# EasyEDA Pro project STM32G303的双FOC电机驱动.eprj, board axdr_v1.2 (continued)
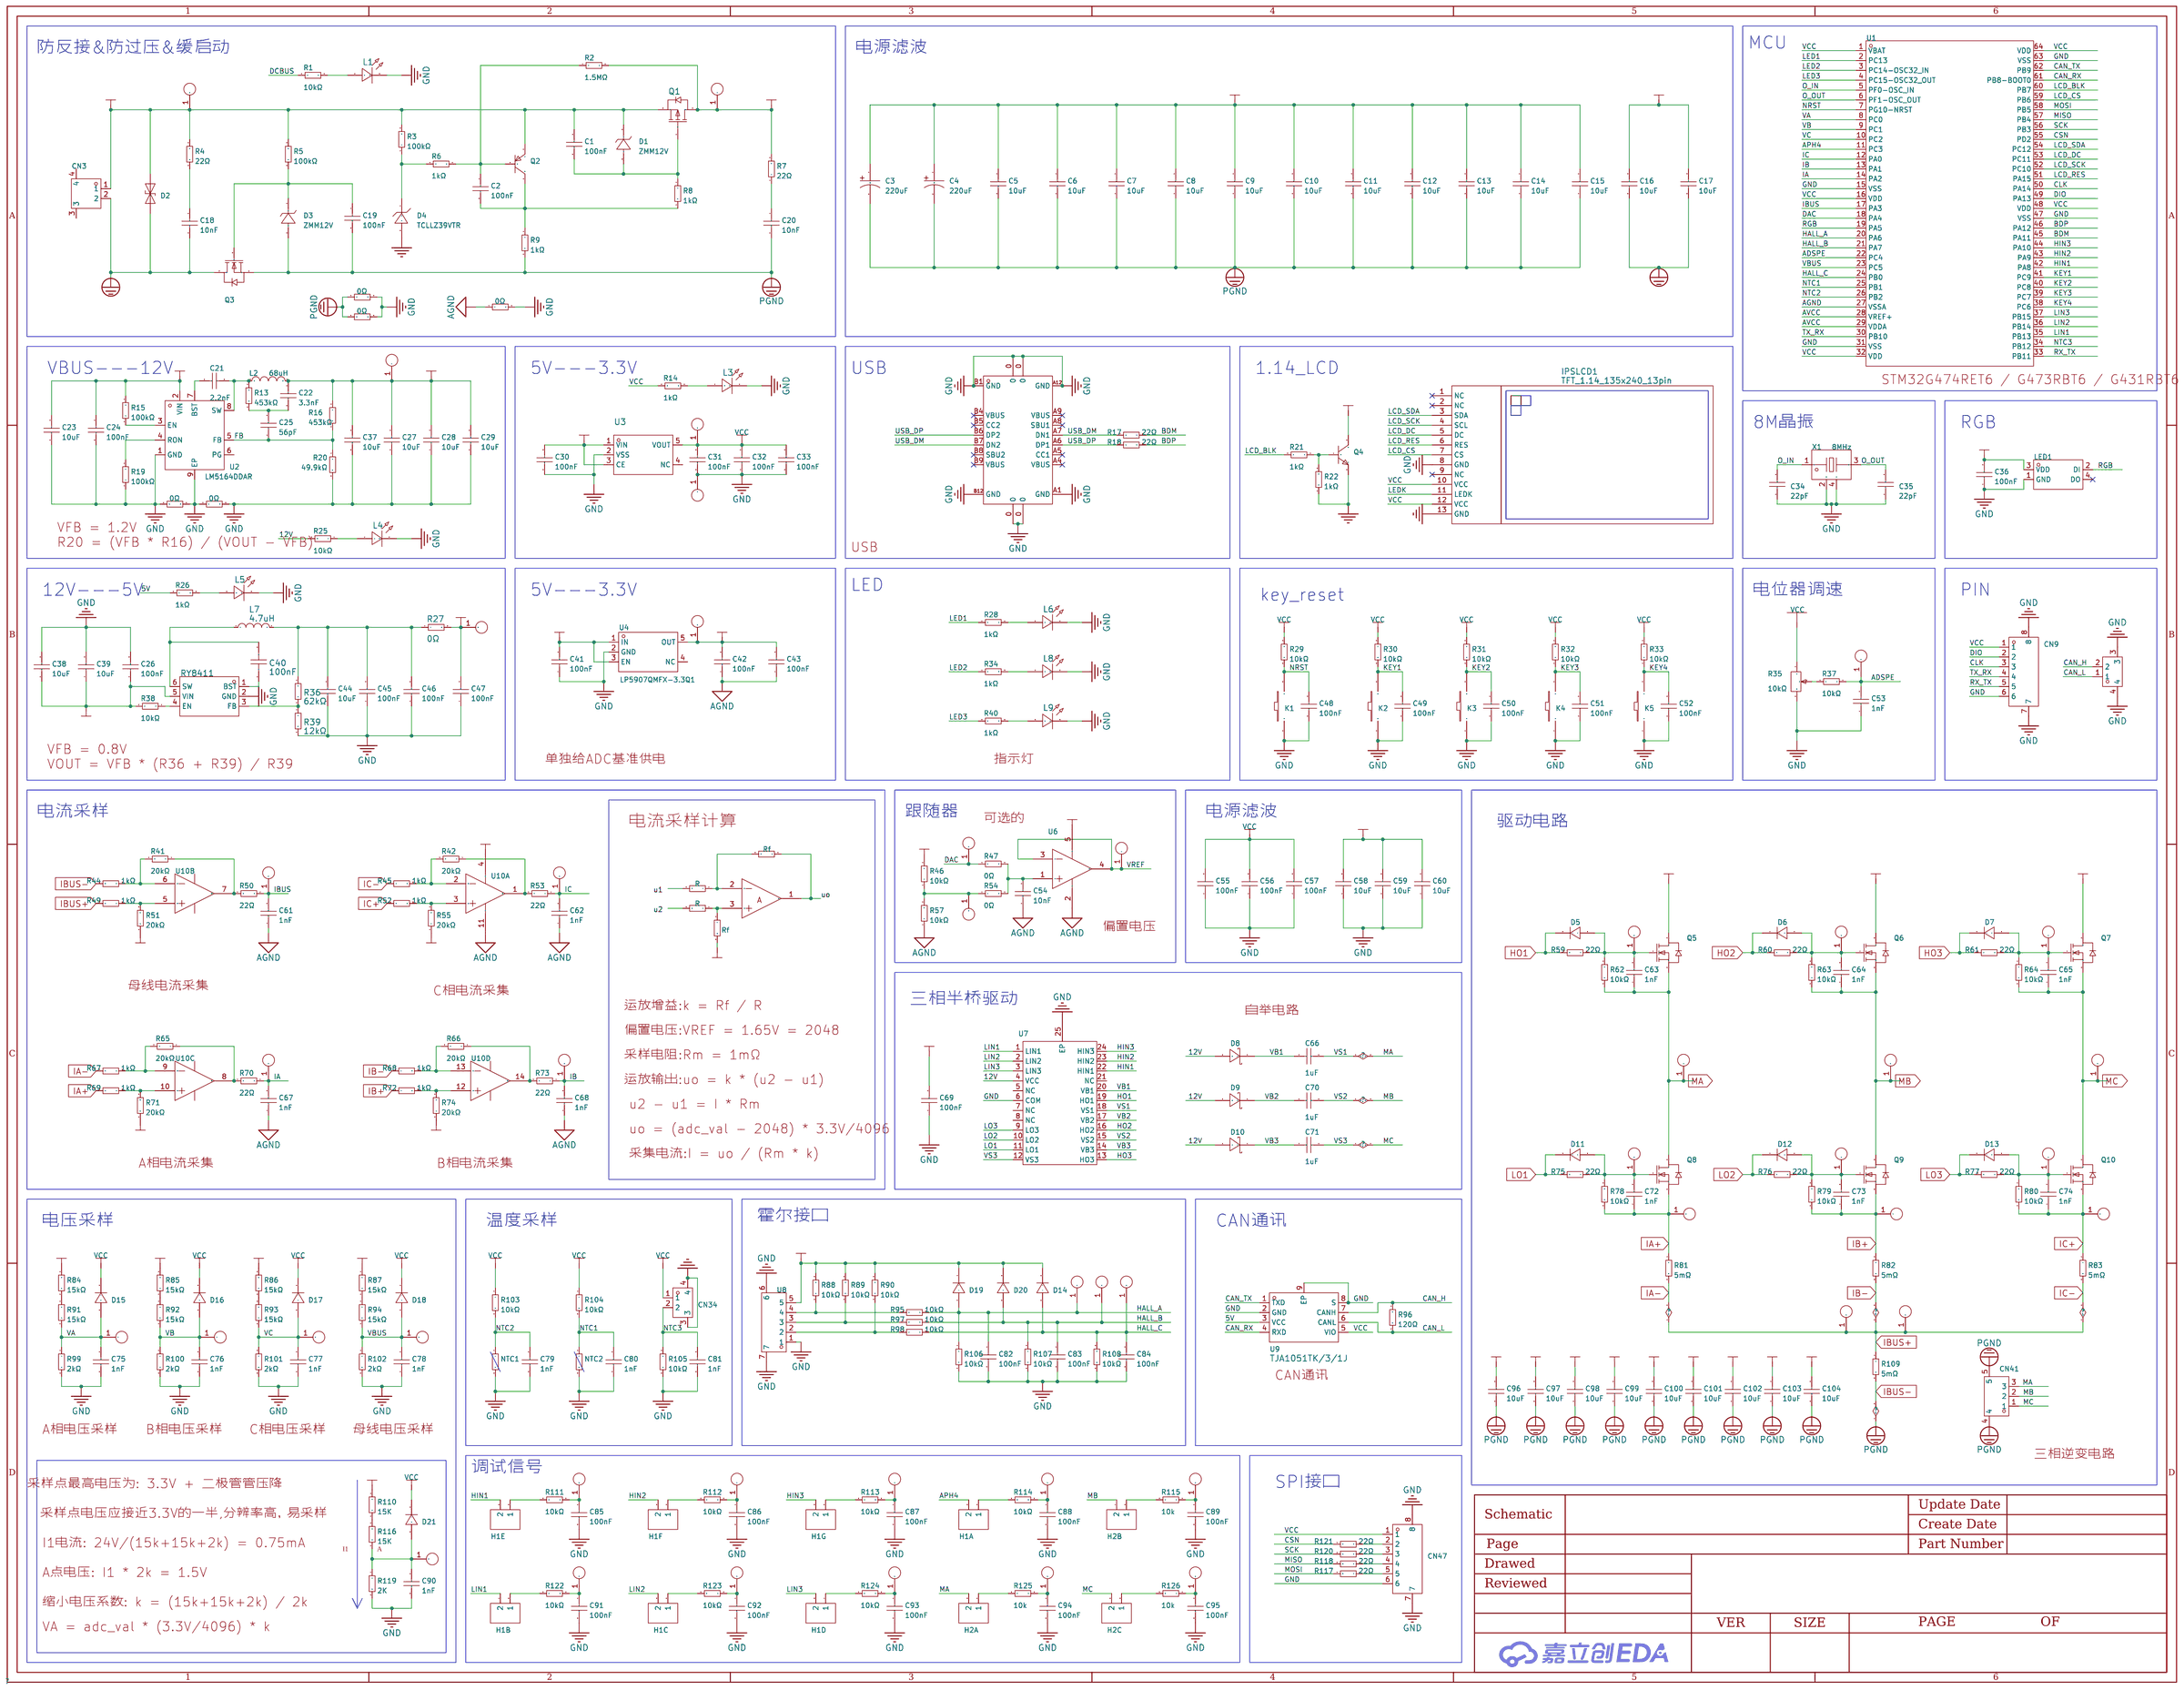
[diagram p0: schematic sheet]
## Routing (per net, layer and track width the routed paths; a pad name or vN(x,y) marks a point on that pad's centre or on a via; arc(x,y) is an arc through that point) (continued)
DCBUS_IN: length 26.9
  Top Layer w0.127: Q1.3 18.72,46.95 19.16,46.51 19.16,45.17 19.42,44.91 20.11,44.91 R4.2
  Top Layer w0.254: v1(22.48,51.15) Q2.2 23.4,51.39 C1.1 ; CN1.1 v1(29.12,53.5) ; R4.2 R5.2 ; D1.1 16.12,49.87 v1(16.12,50.58) R3.2
  Inner2 w0.254: v1(29.12,53.5) 28.82,53.8 23.23,53.8 22.48,53.06 v1(22.48,51.15) 16.64,51.15 16.12,50.63 v1(16.12,50.58)
  vias: v1(0.74,48.49) v1(0.74,47.67) v1(0.74,46.85) v1(0.74,46.03) v1(0.74,45.21) v1(1.46,48.49) v1(1.46,47.67) v1(1.46,46.85) v1(1.46,46.03) v1(1.46,45.21) v1(2.18,48.49) v1(2.18,47.67) v1(2.18,46.85) v1(2.18,46.03) v1(2.18,45.21) v1(2.9,48.49) v1(2.9,47.67) v1(2.9,46.85) v1(2.9,46.03) v1(2.9,45.21) v1(3.62,48.49) v1(3.62,47.67) v1(3.62,46.85) v1(3.62,46.03) v1(3.62,45.21) v1(4.34,48.49) v1(4.34,47.67) v1(4.34,46.85) v1(4.34,46.03) v1(4.34,45.21) v1(5.05,48.49) v1(5.05,47.67) v1(5.05,46.85) v1(5.05,46.03) v1(5.05,45.21) v1(5.77,48.49) v1(5.77,47.67) v1(5.77,46.85) v1(5.77,46.03) v1(5.77,45.21) v1(6.49,48.49) v1(6.49,47.67) v1(6.49,46.85) v1(6.49,46.03) v1(6.49,45.21) v1(7.21,48.49) v1(7.21,47.67) v1(7.21,46.85) v1(7.21,46.03) v1(7.21,45.21) v1(7.93,48.49) v1(7.93,47.67) v1(7.93,46.85) v1(7.93,46.03) v1(7.93,45.21) v1(8.65,48.49) v1(8.65,47.67) v1(8.65,46.85) v1(8.65,46.03) v1(8.65,45.21) v1(9.37,48.49) v1(9.37,47.67) v1(9.37,46.85) v1(9.37,46.03) v1(9.37,45.21) v1(10.09,48.49) v1(10.09,47.67) v1(10.09,46.85) v1(10.09,46.03) v1(10.09,45.21) v1(10.81,48.49) v1(10.81,47.67) v1(10.81,46.85) v1(10.81,46.03) v1(10.81,45.21) v1(11.52,48.49) v1(11.52,47.67) v1(11.52,46.85) v1(11.52,46.03) v1(11.52,45.21) v1(12.24,48.49) v1(12.24,47.67) v1(12.24,46.85) v1(12.24,46.03) v1(12.24,45.21)
DIO: length 66.4
  Top Layer w0.127: v1(6.85,29.63) 6.61,29.4 6.19,29.4 5.76,29.83 CN9.2 ; U1.49 v1(60.38,23.65)
  内层4 w0.127: v1(60.38,23.65) 60.12,23.65 59.73,24.03 59.01,24.03 56.7,21.72 53.63,21.72 51.57,19.66 15.84,19.66 14.34,21.16 14.34,22.94 12.94,24.34 10.4,24.34 9.89,24.85 9.89,28.28 8.79,29.38 7.1,29.38 v1(6.85,29.63)
FB: length 4.6
  Top Layer w0.203: U2.5 27.48,31.13 C25.1 27.23,32.86 R16.2 R20.1
HALL_A: length 53
  Top Layer w0.127: v1(82.83,17.35) CN31.1 84.77,17.35 C82.1 88.06,16.6 ; D19.2 v1(90.79,19.39) ; U1.20 v1(54.38,8.52)
  内层4 w0.127: v1(54.38,8.52) 54.38,9.9 55.23,10.75 73.01,10.75 74.28,12.02 81.14,12.02 82.03,12.91 82.03,17.1 82.28,17.35 v1(82.83,17.35) 89.9,17.35 90.79,18.24 v1(90.79,19.39)
HALL_B: length 53.5
  Top Layer w0.127: D20.2 v1(92.44,19.39) ; v1(82.79,14.47) CN32.1 84.73,14.47 C83.1 86.8,13.67 ; 86.8,13.67 R107.1 ; 86.8,13.67 R97.2 ; U1.21 v1(54.88,8.94)
  内层4 w0.127: v1(92.44,19.39) 92.44,15.2 91.72,14.47 v1(82.79,14.47) 82.41,14.09 82.41,12.78 81.39,11.77 74.41,11.77 73.14,10.5 55.42,10.5 54.88,9.95 v1(54.88,8.94)
HALL_C: length 55.3
  Top Layer w0.127: v1(56.38,8.52) 56.38,8.53 U1.24 ; 86.79,10.76 86.79,10.76 ; 86.79,10.76 85.53,10.76 C84.1 84.76,11.51 CN33.1 v1(82.83,11.51) ; 86.79,10.76 R98.2 ; D14.2 v1(94.09,19.39)
  内层4 w0.127: v1(56.38,8.52) 56.38,9.92 56.69,10.24 73.33,10.24 74.6,11.51 v1(82.83,11.51) 93.21,11.51 94.09,12.4 v1(94.09,19.39)
HIN1: length 48.1
  Top Layer w0.127: v1(60.57,16.83) U1.42 64.53,16.83 64.88,16.48 64.88,11.26 65.62,10.52 73.37,10.52 74.03,9.86 76.95,9.86 77.52,9.29 77.52,8.72 ; U7.22 v1(45.27,25.23)
  Inner2 w0.127: v1(60.57,16.83) 60.26,16.83 59.23,17.86 51.53,17.86 48.12,21.27 48.12,23.01 47.68,23.45 44.11,23.45 43.68,23.88 43.68,24.97 44.06,25.36 45.14,25.36 v1(45.27,25.23)
HIN2: length 49.8
  Top Layer w0.127: U7.23 v1(44.81,24.73) ; v1(60.98,17.33) U1.43 64.72,17.33 65.14,16.92 65.14,11.39 65.75,10.77 73.5,10.77 74.16,10.12 79.62,10.12 80,9.73 80,8.78 80.06,8.72
  Inner2 w0.127: 60.93,17.39 v1(60.98,17.33) 60.21,17.33 59.42,18.12 51.63,18.12 48.5,21.25 48.5,22.99 47.7,23.79 44.23,23.79 44.06,23.96 44.06,24.6 44.18,24.72 44.79,24.72 v1(44.81,24.73)
HIN3: length 49.5
  Top Layer w0.127: 82.6,8.72 82.6,9.8 82.03,10.37 74.41,10.37 73.75,11.03 65.88,11.03 65.39,11.51 65.39,17.23 64.79,17.83 U1.44 v1(60.57,17.83) ; v1(45.27,24.23) U7.24
  Inner2 w0.127: v1(60.57,17.83) 60.15,17.83 59.61,18.37 51.74,18.37 48.88,21.23 48.88,23.07 47.74,24.21 45.29,24.21 v1(45.27,24.23)
HO1: length 10
  Top Layer w0.127: U7.19 45.41,26.73 45.26,26.88 v1(45.26,27.26)
  Top Layer w0.254: R59.2 48.26,30.35 D5.1 49.52,29.09 v1(49.52,28.02)
  内层4 w0.254: v1(45.26,27.26) 49.14,27.26 49.52,27.64 v1(49.52,28.02)
HO2: length 8.1
  Top Layer w0.152: v1(47.56,28.43) U7.16
  Top Layer w0.254: 49.9,30.35 51.13,30.35 51.42,30.05 51.42,29.05 50.78,28.4 v1(50.53,28.4)
  Inner2 w0.254: v1(50.53,28.4) 50.15,28.78 47.92,28.78 v1(47.56,28.43)
HO3: length 7.8
  Top Layer w0.254: D7.1 54.11,30.35 52.88,30.35 52.88,28.52 51.75,27.39 U7.13
IA: length 40.5
  Top Layer w0.127: 80.88,15.64 80.88,14.25 C67.2 80.87,13.53 v1(80.21,12.87) 79.83,12.49 CN20.1 ; U1.14 v1(52.28,13.33)
  Inner2 w0.127: v1(52.28,13.33) 52.44,13.17 52.44,10.88 53.33,9.99 64.31,9.99 65.46,11.13 65.46,13.63 66.13,14.31 68.4,14.31 69.8,12.91 80.18,12.91 v1(80.21,12.87)
IA+: length 39.9
  Top Layer w0.254: v1(82.2,19.26) 81.82,18.88 81.37,18.88 80.92,19.32 ; R81.1 76.76,50.63 77.14,50.25 77.14,47.52 v1(76.82,47.2)
  Inner2 w0.254: v1(76.82,47.2) 77.14,46.88 77.14,45.23 81.27,41.1 81.27,29.8 83.3,27.77 83.3,19.13 83.05,18.88 82.58,18.88 v1(82.2,19.26)
IA-: length 143.5
  Top Layer w0.254: v1(77.84,40.22) 77.52,40.54 77.52,43.27 77.9,43.65 R82.2 ; v1(82.2,18.12) 81.82,18.5 81.37,18.5 80.92,18.05 ; v1(73.39,23.84) 73.01,23.46 73.01,23 R68.1 ; v1(66.03,16.78) 66.41,16.4 66.86,16.4 67.31,16.85 ; R49.1 75.55,11.7 75.55,11.25 v1(75.93,10.86) ; v1(77.84,33.23) 77.52,33.55 77.52,36.28 77.9,36.66 R83.2 ; v1(86.46,33.23) R109.1 ; R81.2 77.9,50.63 77.52,50.25 77.52,47.52 v1(77.84,47.2)
  Inner2 w0.254: v1(77.84,33.23) 77.52,32.91 77.52,29.45 76.6,28.53 74.19,28.53 71.27,25.61 67.46,25.61 64.76,22.91 64.76,16.88 65.17,16.47 65.71,16.47 v1(66.03,16.78) ; v1(82.2,18.12) 82.58,18.5 83.2,18.5 83.68,18.97 83.68,27.93 81.65,29.96 81.65,41.26 77.52,45.39 77.52,46.88 v1(77.84,47.2) ; v1(73.39,23.84) 73.01,24.22 73.01,25.32 74.57,26.88 78.25,26.88 79.87,28.5 79.87,36.05 77.52,38.4 77.52,39.91 v1(77.84,40.22) ; 76.06,10.86 75.77,10.86 75.55,10.65 75.55,10.5 75.81,10.24 83.81,10.24 84.32,10.75 84.32,28.02 86.91,30.62 86.91,32.78 v1(86.46,33.23)
IB: length 43.5
  Top Layer w0.127: CN21.1 78.6,22.56 77.26,22.56 C68.2 ; U1.13 v1(52.69,13.83) ; R73.1 77.26,22.56 ; v1(77.97,22.56) 77.27,22.56
  Inner2 w0.127: v1(52.69,13.83) 52.76,13.77 52.76,10.94 53.45,10.24 64.12,10.24 65.2,11.32 65.2,13.73 67.42,15.96 67.42,21.16 68.82,22.56 v1(77.97,22.56)
IB+: length 30.5
  Top Layer w0.254: R82.1 76.76,43.65 77.14,43.27 77.14,40.54 v1(76.82,40.22) ; v1(72.25,23.84) 72.63,23.46 72.63,23 R72.1
  Inner2 w0.254: v1(76.82,40.22) 77.14,39.91 77.14,38.25 79.49,35.9 79.49,28.66 78.09,27.26 74.41,27.26 72.63,25.48 72.63,24.21 72.26,23.84 v1(72.25,23.84)
IBUS: length 26.6
  Top Layer w0.127: v1(68.19,12.91) 68.91,12.91 CN14.1 69.68,12.14 70.92,12.14 ; C61.2 70.92,12.14 ; 70.92,12.14 R50.1 ; U1.17 v1(52.88,8.52)
  Inner2 w0.127: v1(52.88,8.52) 52.88,9.29 53.33,9.73 64.5,9.73 65.71,10.94 65.71,13.48 66.28,14.05 67.77,14.05 68.19,13.63 v1(68.19,12.91)
IC: length 34.1
  Top Layer w0.127: R53.1 67.3,20.66 ; CN15.1 67.55,22.31 v1(67.17,21.93) 67.17,20.78 C62.2 ; U1.12 v1(52.28,14.33)
  Inner2 w0.127: v1(67.17,21.93) 67.17,16.06 64.88,13.78 64.88,11.45 63.93,10.5 53.64,10.5 53.14,11 53.14,14.05 52.85,14.33 v1(52.28,14.33)
IC+: length 35.5
  Top Layer w0.254: R83.1 76.76,36.66 77.14,36.28 77.14,33.55 v1(76.82,33.23) ; v1(66.03,15.64) 66.41,16.02 66.86,16.02 67.31,15.58
  Inner1 w0.254: 65.9,15.78 65.9,15.77
  Inner2 w0.254: v1(66.03,15.64) 65.58,16.08 65.01,16.08 64.38,16.72 64.38,23.07 67.3,25.99 71.11,25.99 74.03,28.91 76.44,28.91 77.14,29.61 77.14,32.91 v1(76.82,33.23)
KEY1: length 55.8
  Top Layer w0.127: R30.1 18.78,4.26 19.49,4.97 K2.2 v1(27.16,5.76) ; U1.41 v1(63.78,16.33)
  内层3 w0.127: v1(63.78,16.33) 63.48,16.33 62.98,15.83 62.98,13.23 62.03,12.27 59.42,12.27 58.34,11.19 58.34,9.16 56.88,7.7 29.1,7.7 v1(27.16,5.76)
KEY2: length 46.2
  Top Layer w0.127: U1.40 v1(64.19,15.83) ; R31.1 C50.2 29.81,5 29.81,5.76 v1(37.48,5.76)
  内层3 w0.127: v1(64.19,15.83) 63.49,15.83 63.23,15.58 63.23,13.1 62.15,12.02 59.61,12.02 58.66,11.07 58.66,8.85 57.26,7.45 39.16,7.45 v1(37.48,5.76)
KEY3: length 34.7
  Top Layer w0.127: U1.39 v1(63.78,15.33) ; v1(47.8,5.76) K4.2 40.13,4.97 C51.2 R32.1
  内层3 w0.127: v1(63.78,15.33) 63.49,15.05 63.49,12.99 62.26,11.77 59.8,11.77 58.98,10.94 58.98,8.53 57.65,7.19 49.23,7.19 v1(47.8,5.76)
KEY4: length 25.5
  Top Layer w0.127: v1(50.44,5.76) 50.44,4.94 49.77,4.26 R33.1 ; U1.38 v1(64.19,14.83)
  内层3 w0.127: v1(64.19,14.83) 63.74,14.38 63.74,12.89 62.36,11.51 60.06,11.51 59.3,10.75 59.3,6.94 v1(58.11,5.76)
  内层4 w0.127: v1(50.44,5.76) v1(58.11,5.76)
LCD_BLK: length 19.7
  Top Layer w0.127: U1.60 v1(54.88,20.44) ; R21.2 50.33,7.89 v1(50.92,8.49)
  内层3 w0.127: v1(50.92,8.49) 50.92,20.16 51.87,21.1 54.22,21.1 v1(54.88,20.44)
LCD_CS: length 31.2
  Top Layer w0.127: U1.59 55.38,20.04 v1(55.36,20.02) ; IPSLCD1.7 v1(29.96,17.7)
  内层4 w0.127: v1(55.36,20.02) 55.36,19.13 54.73,18.51 32.17,18.51 31.37,17.7 v1(29.96,17.7)
LCD_DC: length 35.2
  Top Layer w0.127: U1.53 v1(58.38,20.44) ; IPSLCD1.5 v1(31.48,16.31)
  内层4 w0.127: 31.48,16.34 31.48,17.1 32.38,18 57.27,18 58.38,19.1 v1(58.38,20.44)
LCD_RES: length 35.5
  Top Layer w0.127: IPSLCD1.6 v1(32.66,17) ; U1.51 v1(59.38,20.44)
  内层4 w0.127: v1(32.66,17) 33.14,17.49 57.78,17.49 59.38,19.09 v1(59.38,20.44)
LCD_SCK: length 36.2
  Top Layer w0.127: IPSLCD1.4 v1(31.48,15.6) ; U1.52 v1(58.88,20.02)
  内层4 w0.127: v1(31.48,15.6) 32.12,16.24 32.12,17.23 32.64,17.75 57.53,17.75 58.88,19.1 v1(58.88,20.02)
LCD_SDA: length 35.5
  Top Layer w0.127: IPSLCD1.3 v1(29.96,14.9) ; U1.54 v1(57.88,20.02)
  内层4 w0.127: v1(29.96,14.9) 30.72,15.67 30.72,16.7 32.28,18.25 57.03,18.25 57.88,19.1 v1(57.88,20.02)
LED1: length 28.8
  Top Layer w0.127: U1.2 49.76,19.33 49.52,19.58 49.52,20.34 48.82,21.04 46.03,21.04 45.39,21.67 v1(43.93,21.67)
  内层4 w0.127: v1(43.93,21.67) 40.58,21.67 35.86,26.39 35.86,31.6 37.19,32.93 38.16,32.93 39.12,33.88 v1(39.12,34.86)
LED2: length 28.3
  Top Layer w0.127: v1(44.31,21.16) 45.52,21.16 45.9,20.78 48.71,20.78 49.2,20.3 49.2,19.45 49.82,18.83 U1.3
  内层4 w0.127: v1(44.31,21.16) 40.73,21.16 35.61,26.29 35.61,31.77 37.85,34 v1(37.85,34.86)
LED3: length 28.5
  Top Layer w0.127: U1.4 49.81,18.33 48.88,19.26 48.88,20.08 48.44,20.53 45.77,20.53 45.64,20.66 v1(43.93,20.66) ; 43.97,20.63 43.97,20.62
  Top Layer w0.203: v1(43.93,20.66) 43.97,20.62
  内层4 w0.127: v1(36.58,34.86) 36.58,33.24 35.36,32.02 35.36,26.18 40.88,20.66 v1(43.93,20.66)
LEDK: length 28.6
  Top Layer w0.127: IPSLCD1.11 35.06,20.5 36.18,19.39 36.18,12.65 36.7,12.13 46.57,12.13 47.33,11.37 Q4.3
LIN1: length 33.5
  Top Layer w0.127: U7.1 v1(46.56,22.94) ; v1(60.57,13.33) U1.35 63.82,13.33 64.12,13.04 64.12,10.9 65.26,9.76 69.56,9.76 69.9,9.42 69.9,8.72
  Inner2 w0.127: v1(46.56,22.94) 46.6,22.9 46.6,21.69 51.19,17.1 58.6,17.1 59.68,16.02 59.68,13.91 60.25,13.33 v1(60.57,13.33)
LIN2: length 36
  Top Layer w0.127: v1(60.98,13.83) U1.36 63.96,13.83 64.38,13.42 64.38,11 65.37,10.01 72.25,10.01 72.44,9.82 72.44,8.72 ; U7.2 v1(47.06,22.53)
  Inner2 w0.127: v1(47.06,22.53) 47.06,21.59 51.3,17.35 58.85,17.35 60.06,16.15 60.06,14.12 60.34,13.83 v1(60.98,13.83) 60.95,13.8
LIN3: length 37.3
  Top Layer w0.127: v1(60.57,14.33) U1.37 63.97,14.33 64.63,13.67 64.63,11.11 65.47,10.27 73.11,10.27 74.66,8.72 74.98,8.72 ; v1(47.56,22.94) U7.3
  Inner2 w0.127: v1(47.56,22.94) 47.56,21.47 51.42,17.61 59.04,17.61 60.57,16.08 v1(60.57,14.33)
LO1: length 7.8
  Top Layer w0.254: U7.11 55.51,26.23 R75.2 56.97,26 D11.1
LO2: length 11.8
  Top Layer w0.254: D12.1 60.02,26 58.84,26 58.84,25.35 58.48,24.99 54.84,24.99 54.09,25.73 U7.10
LO3: length 15.3
  Top Layer w0.254: D13.1 63.07,26 R77.2 61.84,24.97 61.33,24.47 54.34,24.47 53.58,25.23 U7.9
MA: length 63.5
  Top Layer w0.127: R84.1 v1(71.13,33.23)
  Top Layer w0.152: C66.1 43.23,31.01 44.63,31.01 44.98,30.65 44.98,28.62 45.58,28.02 v1(46.56,28.02) U7.18
  Inner2 w0.152: v1(71.13,33.23) 75.04,33.23 75.43,33.61 v1(75.43,48.22)
  Inner2 w0.254: v1(46.56,28.02) 46.56,28.75 47.1,29.29 52.25,29.29 54.66,31.71 54.66,46.66 v1(61.12,53.11)
  vias: v1(61.12,52.29) v1(61.12,51.47) v1(61.12,50.66) v1(61.12,49.83) v1(61.12,49.02) v1(61.1,48.2) v1(61.82,48.2) v1(61.83,53.11) v1(61.83,52.29) v1(61.83,51.47) v1(61.83,50.66) v1(61.83,49.83) v1(61.83,49.02) v1(62.55,53.11) v1(62.55,52.29) v1(62.55,51.47) v1(62.55,50.66) v1(62.55,49.83) v1(62.55,49.02) v1(62.54,48.2) v1(63.27,53.11) v1(63.27,52.29) v1(63.27,51.47) v1(63.27,50.66) v1(63.27,49.83) v1(63.27,49.02) v1(63.26,48.2) v1(63.99,53.11) v1(63.99,52.29) v1(63.99,51.47) v1(63.99,50.66) v1(63.99,49.83) v1(63.99,49.02) v1(63.98,48.2) v1(64.71,53.11) v1(64.71,52.29) v1(64.71,51.47) v1(64.71,50.66) v1(64.71,49.83) v1(64.71,49.02) v1(64.69,48.2) v1(65.41,48.2) v1(65.43,53.11) v1(65.43,52.29) v1(65.43,51.47) v1(65.43,50.66) v1(65.43,49.83) v1(65.43,49.02) v1(66.15,53.11) v1(66.15,52.29) v1(66.15,51.47) v1(66.15,50.66) v1(66.15,49.83) v1(66.15,49.02) v1(66.15,48.2)
MB: length 49
  Top Layer w0.127: v1(76.06,33.23) 76.08,33.21 R85.1
  Top Layer w0.152: C70.1 43.19,33.99 45.2,33.99 45.64,33.55 45.64,29.48 46.22,28.91 47.74,28.91 48.06,28.59 v1(48.06,28.02) U7.15
  Inner2 w0.152: v1(76.06,33.23) v1(76.06,41.23)
  Inner2 w0.254: v1(48.06,28.02) 48.69,27.39 51.55,27.39 55.23,31.07 55.23,40.25 v1(61.12,46.13)
  vias: v1(61.12,45.31) v1(61.12,44.49) v1(61.12,43.67) v1(61.12,42.85) v1(61.12,42.03) v1(61.1,41.21) v1(61.82,41.21) v1(61.83,46.13) v1(61.83,45.31) v1(61.83,44.49) v1(61.83,43.67) v1(61.83,42.85) v1(61.83,42.03) v1(62.55,46.13) v1(62.55,45.31) v1(62.55,44.49) v1(62.55,43.67) v1(62.55,42.85) v1(62.55,42.03) v1(62.54,41.21) v1(63.27,46.13) v1(63.27,45.31) v1(63.27,44.49) v1(63.27,43.67) v1(63.27,42.85) v1(63.27,42.03) v1(63.26,41.21) v1(63.99,46.13) v1(63.99,45.31) v1(63.99,44.49) v1(63.99,43.67) v1(63.99,42.85) v1(63.99,42.03) v1(63.98,41.21) v1(64.71,46.13) v1(64.71,45.31) v1(64.71,44.49) v1(64.71,43.67) v1(64.71,42.85) v1(64.71,42.03) v1(64.69,41.21) v1(65.41,41.21) v1(65.43,46.13) v1(65.43,45.31) v1(65.43,44.49) v1(65.43,43.67) v1(65.43,42.85) v1(65.43,42.03) v1(66.15,46.13) v1(66.15,45.31) v1(66.15,44.49) v1(66.15,43.67) v1(66.15,42.85) v1(66.15,42.03) v1(66.15,41.21)
MC: length 43.9
  Top Layer w0.127: R86.1 78.97,30.57 78.6,30.94 v1(78.6,34.37)
  Top Layer w0.152: U7.12 50.53,26.73 v1(50.66,26.86)
  Top Layer w0.254: v1(41.48,36.19) C71.1
  Inner2 w0.254: v1(50.66,26.86) 52.04,26.86 55.87,30.69 55.87,33.9 v1(61.12,39.14)
  内层4 w0.254: v1(50.66,26.86) 49.75,26.86 49.52,26.63 42.29,26.63 41.45,27.46 41.45,36.21
  vias: v1(61.12,38.32) v1(61.12,37.5) v1(61.12,36.69) v1(61.12,35.86) v1(61.12,35.05) v1(61.1,34.23) v1(61.82,34.23) v1(61.83,39.14) v1(61.83,38.32) v1(61.83,37.5) v1(61.83,36.69) v1(61.83,35.86) v1(61.83,35.05) v1(62.55,39.14) v1(62.55,38.32) v1(62.55,37.5) v1(62.55,36.69) v1(62.55,35.86) v1(62.55,35.05) v1(62.54,34.23) v1(63.27,39.14) v1(63.27,38.32) v1(63.27,37.5) v1(63.27,36.69) v1(63.27,35.86) v1(63.27,35.05) v1(63.26,34.23) v1(63.99,39.14) v1(63.99,38.32) v1(63.99,37.5) v1(63.99,36.69) v1(63.99,35.86) v1(63.99,35.05) v1(63.98,34.23) v1(64.71,39.14) v1(64.71,38.32) v1(64.71,37.5) v1(64.71,36.69) v1(64.71,35.86) v1(64.71,35.05) v1(64.69,34.23) v1(65.41,34.23) v1(65.43,39.14) v1(65.43,38.32) v1(65.43,37.5) v1(65.43,36.69) v1(65.43,35.86) v1(65.43,35.05) v1(66.15,39.14) v1(66.15,38.32) v1(66.15,37.5) v1(66.15,36.69) v1(66.15,35.86) v1(66.15,35.05) v1(66.15,34.23)
MISO: length 33.1
  Top Layer w0.127: U1.57 v1(56.38,23.23) ; v1(85.46,25.61) R118.2
  内层4 w0.127: v1(56.38,23.23) 56.38,24.47 57.52,25.61 v1(85.46,25.61)
MOSI: length 34.1
  Top Layer w0.127: U1.58 v1(55.88,23.65) ; v1(85.46,26.88) R117.2
  内层4 w0.127: v1(85.46,26.88) 84.44,25.86 57.26,25.86 55.88,24.48 v1(55.88,23.65)
NRST: length 53.9
  Top Layer w0.127: R29.1 C48.2 9.17,5 K1.2 K1.2 ; v1(49.26,15.96) 49.26,16.34 49.76,16.83 U1.7
  内层3 w0.127: v1(49.26,15.96) 49.26,8.68 48.54,7.96 18.95,7.96 v1(16.75,5.76)
NTC1: length 36.1
  Top Layer w0.127: v1(53.84,26.75) 53.84,28.28 54.28,28.72 54.7,28.72 55.61,29.63 55.61,30.05 55.88,30.32 C80.2 57.59,30.32 59.1,31.82 R104.2 ; U1.25 v1(56.88,12.4)
  内层3 w0.127: v1(56.88,12.4) 57.26,12.78 61.65,12.78 62.41,13.54 62.41,18.75 60.88,20.28 60.88,24.47 60.38,24.97 55.61,24.97 v1(53.84,26.75)
NTC2: length 32.9
  Top Layer w0.127: R103.2 64.38,31.59 NTC1.1 C79.2 61.84,29.42 62.09,29.17 63.74,29.17 64.5,28.4 v1(64.5,27.01) ; U1.26 v1(57.38,11.98)
  内层3 w0.127: v1(57.38,11.98) 57.92,12.53 61.84,12.53 62.73,13.42 62.73,18.85 61.16,20.42 61.16,25.44 62.73,27.01 v1(64.5,27.01)
NTC3: length 63.1
  Top Layer w0.127: v1(93.22,31.96) C81.2 94.47,31.18 R105.1 94.49,31.2 95.49,31.2 96.13,31.83 96.13,34.12 95.88,34.36 CN34.2 ; v1(64.57,9.04) 64.57,10.05 63.87,10.75 63.87,12.4 63.44,12.83 U1.34
  Inner2 w0.127: v1(93.22,31.96) 93.22,11.53 v1(91.62,9.92)
  内层4 w0.127: v1(91.62,9.92) 65.46,9.92 v1(64.57,9.04)
O_IN: length 7.2
  Top Layer w0.127: C34.2 46.36,17.81 X1.1 47.43,16.72 48.63,16.72 49.74,17.83 U1.5
O_OUT: length 5.3
  Top Layer w0.127: C35.2 47.98,15.52 49.79,17.33 U1.6
RGB: length 80
  Top Layer w0.127: LED1.2 2.78,34.73 v1(2.78,35.96) ; U1.19 v1(53.88,8.94)
  内层4 w0.127: v1(53.88,8.94) 53.88,8.62 53.21,7.96 10.78,7.96 9.26,9.48 9.26,26.63 7.86,28.02 3.92,28.02 3.35,28.59 3.35,35.39 v1(2.78,35.96)
RX_TX: length 82.4
  Top Layer w0.127: v1(63.87,9.04) 63.87,10.24 63.61,10.5 63.61,12.02 63.3,12.33 U1.33 ; CN9.5 5.67,26.08 6.21,26.63 6.59,26.63 v1(6.85,26.37)
  内层4 w0.127: v1(63.87,9.04) 63.36,8.53 61.77,8.53 61.62,8.38 61.62,7.66 61.28,7.32 10.55,7.32 8.62,9.25 8.62,25.86 7.86,26.63 7.1,26.63 v1(6.85,26.37)
SCK: length 32.9
  Top Layer w0.127: U1.56 v1(56.88,23.65) ; v1(85.46,24.34) R120.2
  内层4 w0.127: v1(85.46,24.34) 84.44,25.36 57.77,25.36 56.88,24.46 v1(56.88,23.65)
TX_RX: length 78.4
  Top Layer w0.127: v1(59.93,8.72) 59.38,9.27 U1.30 ; v1(6.85,27.13) 6.61,26.9 6.19,26.9 5.76,27.33 CN9.4
  内层4 w0.127: v1(59.93,8.72) 61.2,8.72 61.37,8.55 61.37,7.77 61.18,7.58 10.66,7.58 8.88,9.35 8.88,25.97 7.97,26.88 7.1,26.88 v1(6.85,27.13)
USB_DM: length 6.9
  Top Layer w0.127: USBC1.B7 7.94,11.76 v1(6.98,11.75) ; v1(6.97,10.75) 7.93,10.75 USBC1.A7 8.87,10.75 9.26,10.37 9.26,9.61 9.77,9.1 10.79,9.1
  Bottom Layer w0.127: v1(6.97,10.75) 6.98,10.75 v1(6.98,11.75)
USB_DP: length 6.9
  Top Layer w0.127: 10.79,10.37 9.77,10.37 8.88,11.25 USBC1.A6 7.93,11.26 6.72,11.26 6.46,11 6.46,10.5 6.71,10.25 USBC1.B6
VA: length 41.7
  Top Layer w0.127: D15.2 72.63,28.2 72.63,29.31 ; D15.2 72.93,27.9 CN37.1 ; D15.2 72.63,27.61 72.63,25.25 v1(71.21,23.83) ; U1.8 v1(52.28,16.33)